# EasyEDA Pro project Arduino UNO DIY.eprj, schematic Schematic2
Board Name: CH340B Module; Create Date: 2025-09-15; Page Name: P1; Project Name: Arduino UNO DIY; Schematic Name: Schematic2; Update Date: 2025-09-24; Company: m039; Drawn: Dmitry Mozgin; Page Size: A4; Version: V1.0
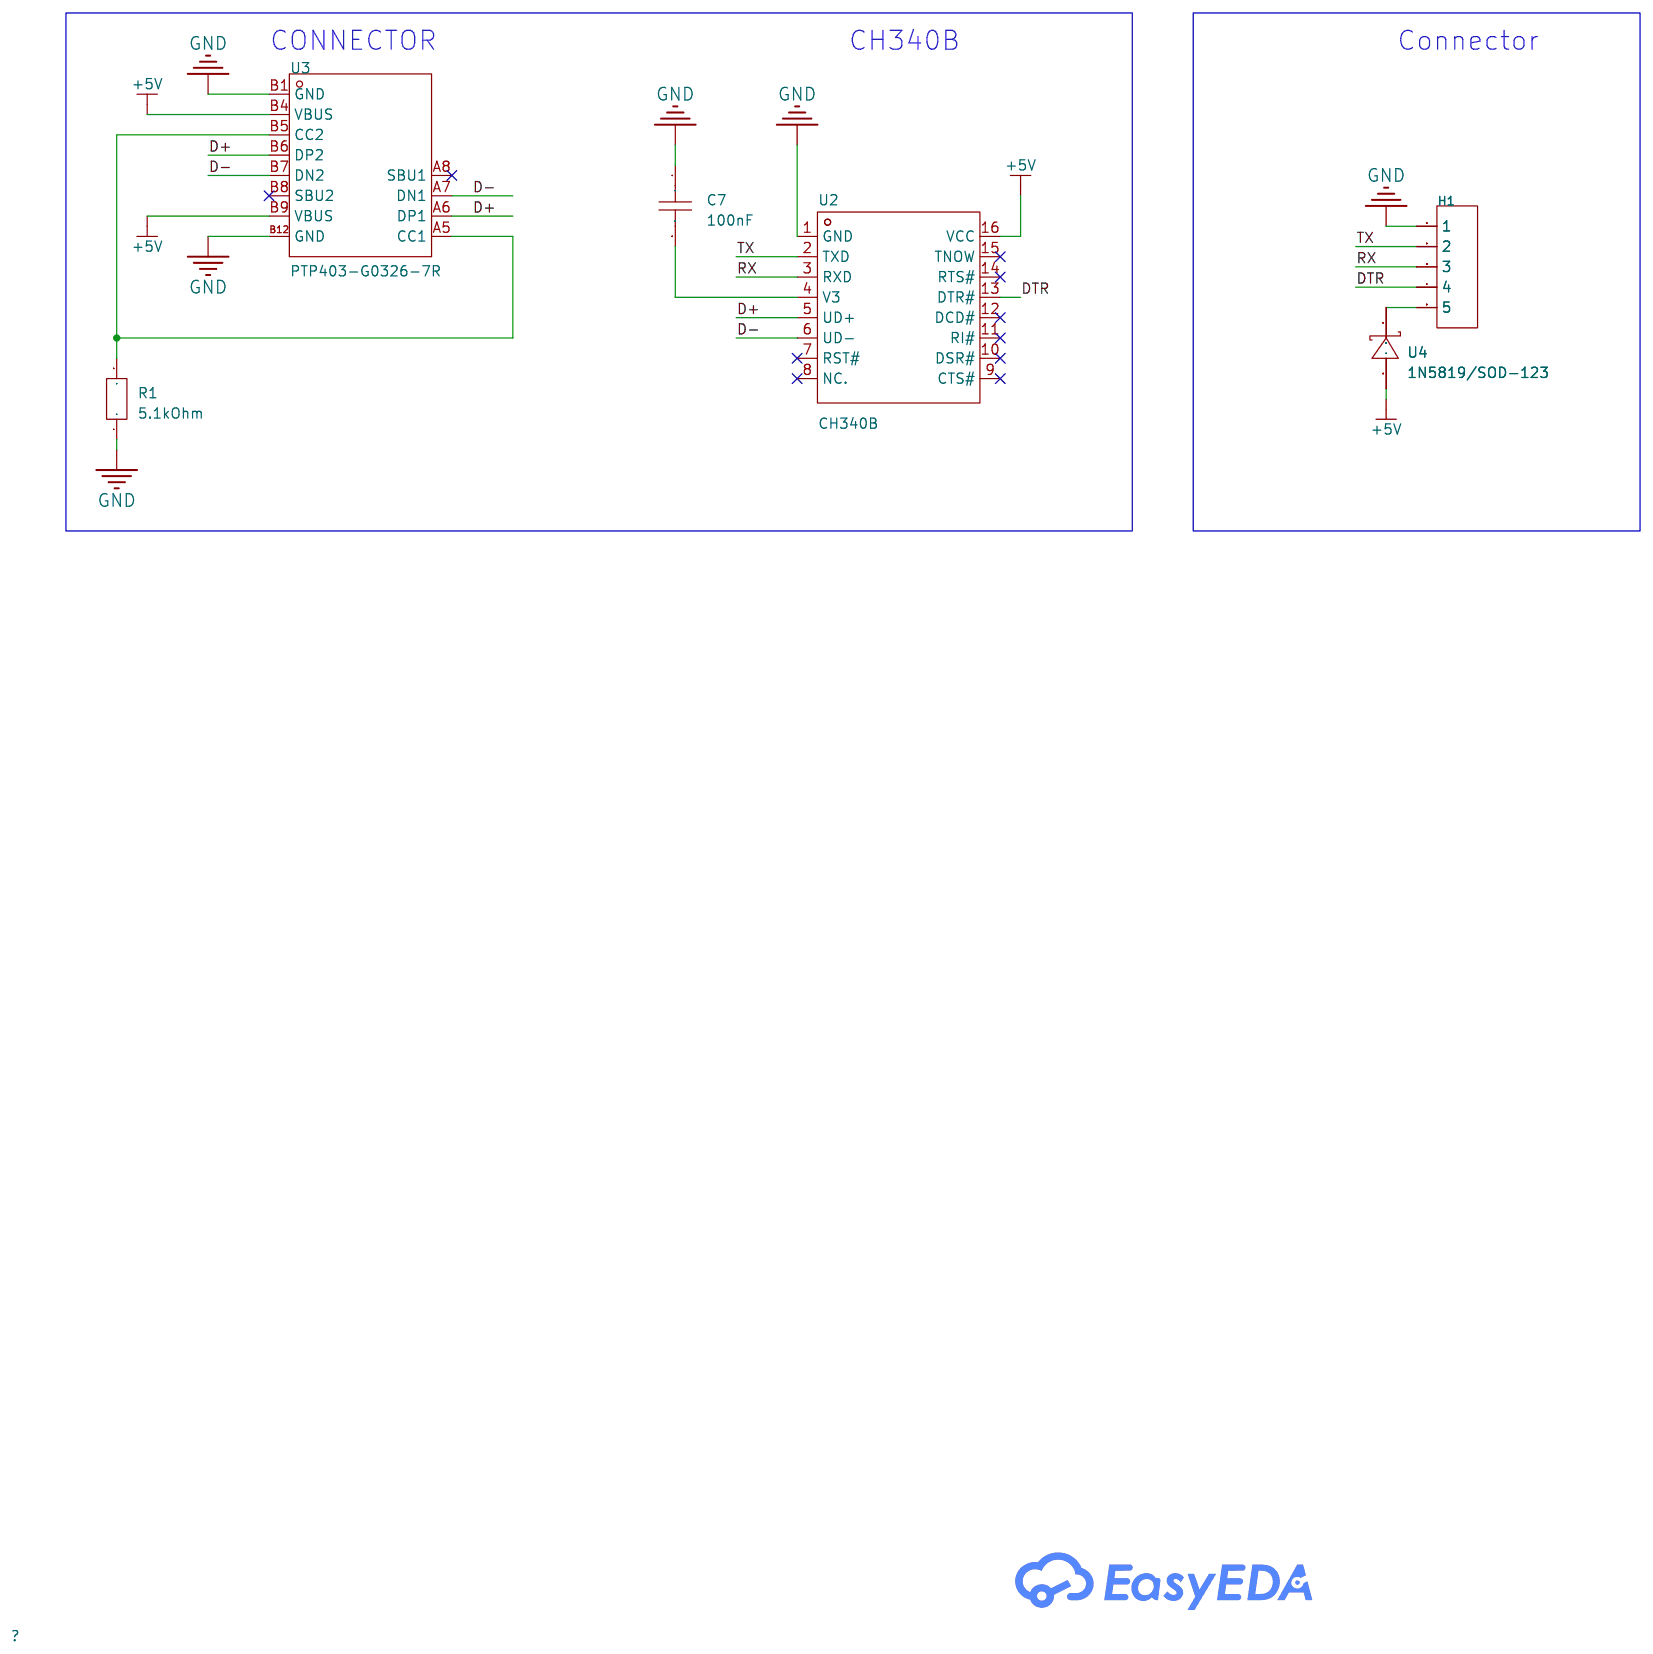
[diagram p1: schematic sheet]

## Parts
C7  100nF  [C0805]
H1  -  [HDR-TH_5P-P2.54-V-F]
R1  5.1kOhm  [R0805]
U2  CH340B  [SOIC-16_L9.9-W3.9-P1.27-LS6.0-BL]
U3  PTP403-G0326-7R  [USB_16PIN_FLAT]
U4  1N5819/SOD-123  [SOD-123_L2.7-W1.7-LS3.8-RD]

## Library data of the parts
C7 = CAP_0805: Supplier Footprint: 0805
H1 = HDR-F_2.54_1x5P: Supplier Footprint: Through
R1 = Resistor 0805
U2 = CH340B: Applications Function:Transceiver USB Protocol:USB 2.0 Voltage - Supply:3.3V；5V Voltage - Supply:3.3V；5V Data Rate:2Mbps; Supplier Part: C81010; Manufacturer: WCH(南京沁恒); Supplier Footprint: SOP-16; JLCPCB Part Class: Extended Part; Datasheet: https://item.szlcsc.com/datasheet/CH340B/82160.html; Supplier: LCSC; Applications Function: Transceiver; USB Protocol: USB 2.0; Voltage - Supply: 3.3V；5V; Data Rate: 2Mbps
U3 = PTP403-G0326-7R: Supplier Part: C9900000187; Supplier Footprint: USB3-TYPEC-16PIN-COM; JLCPCB Part Class: Extended Part; Supplier: LCSC
U4 = 1N5819/SOD-123: Supplier: LCSC; Supplier Part: C9900010912; Manufacturer: null; JLCPCB Part Class: Extended Part

## Nets
+5V: U2.16(VCC) U3.B4(VBUS) U3.B9(VBUS) U4.2(A)
GND: C7.1 H1.1 R1.1 U2.1(GND) U3.B1(GND) U3.B12(GND)
D+: U2.5(UD+) U3.A6(DP1) U3.B6(DP2)
D-: U2.6(UD-) U3.A7(DN1) U3.B7(DN2)
DTR: H1.4 U2.13(DTR#)
RX: H1.3 U2.3(RXD)
TX: H1.2 U2.2(TXD)
$1N284: C7.2 U2.4(V3)
$1N639: R1.2 U3.A5(CC1) U3.B5(CC2)
$1N2711: H1.5 U4.1(C)

Not connected (* = marked no-connect by the designer): U2 7(RST#)* 8(NC.)* 9(CTS#)* 10(DSR#)* 11(RI#)* 12(DCD#)* 14(RTS#)* 15(TNOW)*; U3 A8(SBU1)* B8(SBU2)*

## Notes on the sheet
- CONNECTOR
- CH340B
- Connector
